# EasyEDA Pro project ProProject_IMUSensorNodes202312.epro, board 6_6_拼板20240123（带编号） (continued)
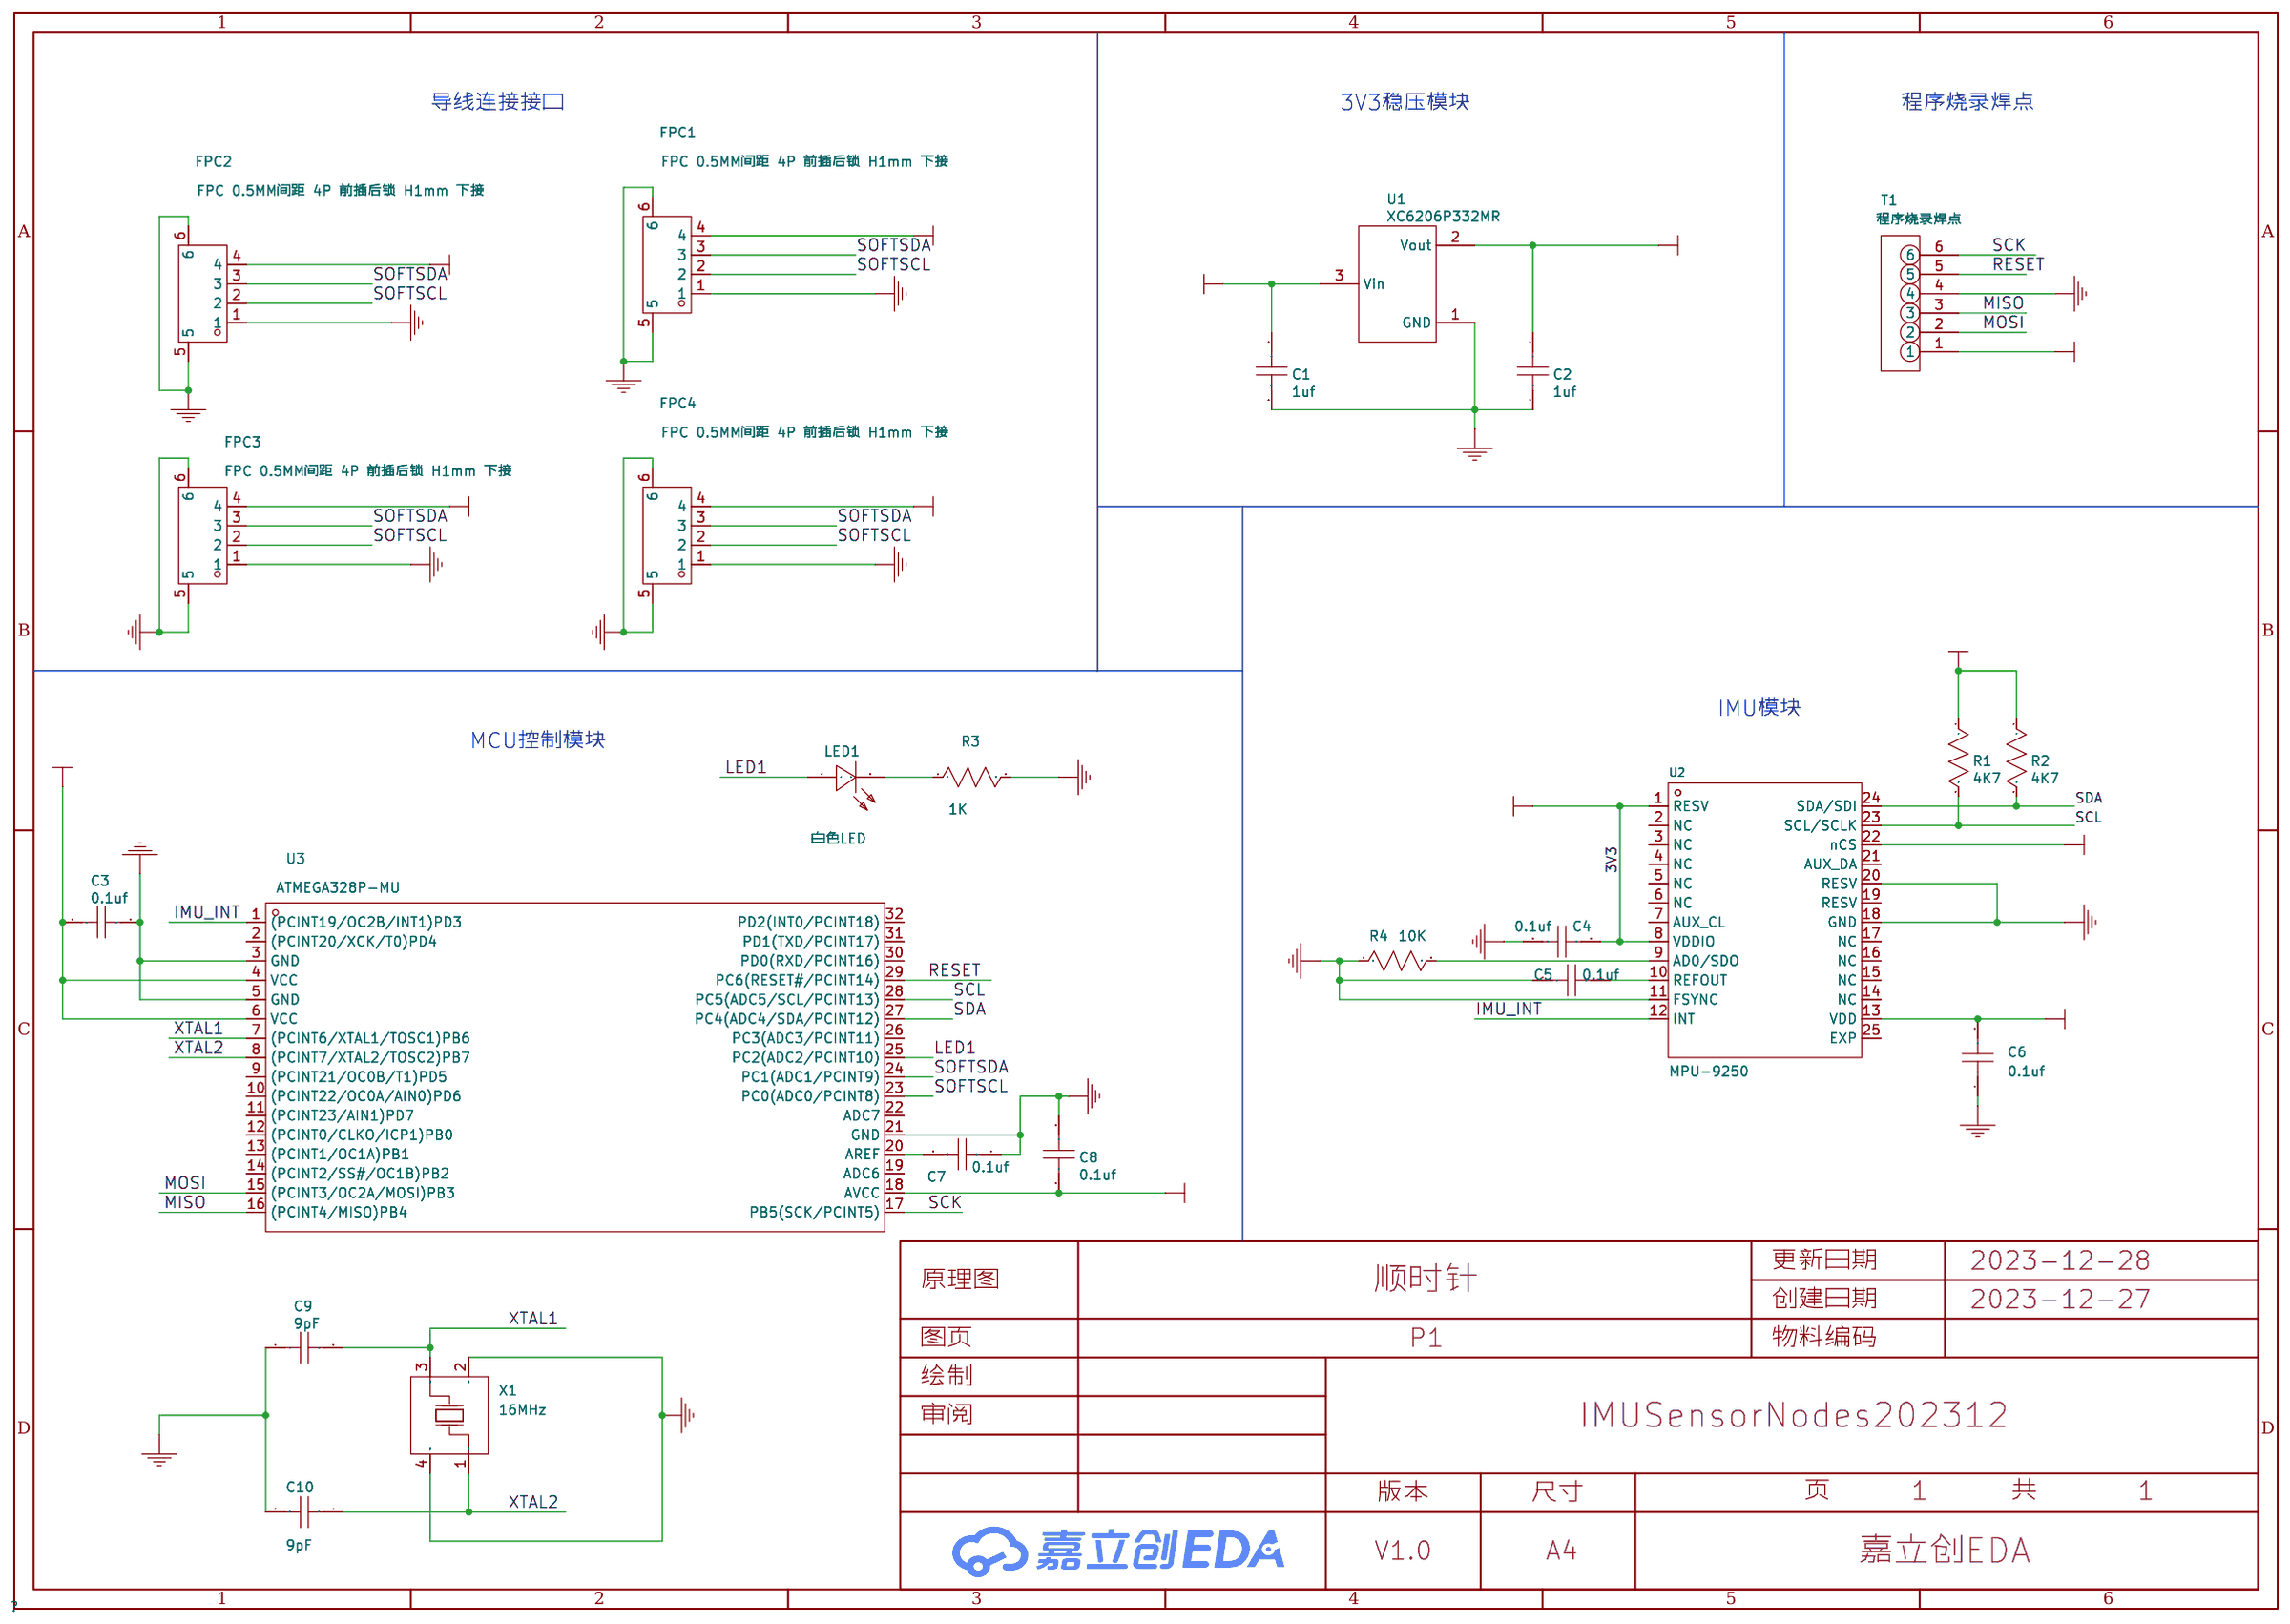
[diagram p0: schematic sheet]
## Routing (per net, layer and track width the routed paths; a pad name or vN(x,y) marks a point on that pad's centre or on a via; arc(x,y) is an arc through that point) (continued)
XTAL1: length 220.2
  Bottom Layer w0.2: v1(8.49,51.34) 8.49,50.14 6.89,48.54 6.13,48.54 5.6,48.02 Designator#803.7 ; Designator#910.7 73.92,6.87 74.2,7.14 74.91,7.14 76.74,8.97 v1(76.74,10.19) ; v1(76.74,23.91) 76.74,22.68 74.91,20.86 74.2,20.86 73.92,20.58 Designator#895.7 ; v1(8.49,65.05) 8.49,63.86 6.89,62.26 6.13,62.26 5.6,61.73 Designator#811.7 ; v1(35.79,37.62) 35.79,36.43 34.19,34.83 33.43,34.83 32.9,34.3 Designator#827.7 ; Designator#896.7 60.21,61.73 60.74,62.26 61.5,62.26 63.1,63.86 v1(63.1,65.05) ; v1(8.49,23.91) 8.49,22.71 6.89,21.11 6.13,21.11 5.6,20.58 Designator#837.7 ; Designator#808.7 32.9,61.73 33.43,62.26 34.19,62.26 35.79,63.86 v1(35.79,65.05) ; v1(49.43,10.19) 49.43,8.97 47.61,7.14 46.89,7.14 46.62,6.87 Designator#838.7 ; Designator#822.7 19.31,34.3 19.59,34.57 20.31,34.57 22.13,36.4 v1(22.13,37.62) ; v1(49.43,37.62) 49.43,36.4 47.61,34.57 46.89,34.57 46.62,34.3 Designator#839.7 ; Designator#913.7 19.31,6.87 19.59,7.14 20.31,7.14 22.13,8.97 v1(22.13,10.19) ; v1(63.1,10.19) 63.1,9 61.5,7.4 60.74,7.4 60.21,6.87 Designator#832.7 ; v1(63.1,23.91) 63.1,22.71 61.5,21.11 60.74,21.11 60.21,20.58 Designator#829.7 ; v1(22.13,23.91) 22.13,22.68 20.31,20.86 19.59,20.86 19.31,20.58 Designator#904.7 ; Designator#917.7 5.6,6.87 6.13,7.4 6.89,7.4 8.49,9 v1(8.49,10.19) ; v1(63.1,78.77) 63.1,77.58 61.5,75.97 60.74,75.97 60.21,75.45 Designator#903.7 ; Designator#810.7 73.92,75.45 74.2,75.72 74.91,75.72 76.74,77.55 v1(76.74,78.77) ; v1(35.79,78.77) 35.79,77.58 34.19,75.97 33.43,75.97 32.9,75.45 Designator#313.7 ; v1(22.13,78.77) 22.13,77.55 20.31,75.72 19.59,75.72 19.31,75.45 Designator#820.7 ; v1(76.74,65.05) 76.74,63.83 74.91,62 74.2,62 73.92,61.73 Designator#809.7 ; Designator#806.7 32.9,6.87 33.43,7.4 34.19,7.4 35.79,9 v1(35.79,10.19) ; v1(49.43,51.34) 49.43,50.11 47.61,48.29 46.89,48.29 46.62,48.02 Designator#322.7 ; v1(22.13,65.05) 22.13,63.83 20.31,62 19.59,62 19.31,61.73 Designator#835.7 ; v1(8.49,37.62) 8.49,36.43 6.89,34.83 6.13,34.83 5.6,34.3 Designator#440.7 ; Designator#325.7 5.6,75.45 6.13,75.97 6.89,75.97 8.49,77.58 v1(8.49,78.77) ; Designator#902.7 19.31,48.02 19.59,48.29 20.31,48.29 22.13,50.11 v1(22.13,51.34) ; Designator#892.7 60.21,34.3 60.74,34.83 61.5,34.83 63.1,36.43 v1(63.1,37.62) ; Designator#889.7 46.62,75.45 46.89,75.72 47.61,75.72 49.43,77.55 v1(49.43,78.77) ; v1(63.1,51.34) 63.1,50.14 61.5,48.54 60.74,48.54 60.21,48.02 Designator#920.7 ; Designator#906.7 73.92,48.02 74.2,48.29 74.91,48.29 76.74,50.11 v1(76.74,51.34) ; v1(49.43,23.91) 49.43,22.68 47.61,20.86 46.89,20.86 46.62,20.58 Designator#885.7 ; v1(35.79,51.34) 35.79,50.14 34.19,48.54 33.43,48.54 32.9,48.02 Designator#916.7 ; Designator#324.7 46.62,61.73 46.89,62 47.61,62 49.43,63.83 v1(49.43,65.05) ; Designator#801.7 73.92,34.3 74.2,34.57 74.91,34.57 76.74,36.4 v1(76.74,37.62) ; v1(35.79,23.91) 35.79,22.71 34.19,21.11 33.43,21.11 32.9,20.58 Designator#321.7
  Bottom Layer w0.254: Designator#593.2 35.84,10.34 35.84,10.19 ; 22.64,51.84 v1(22.13,51.34) ; Designator#449.2 8.54,37.78 8.54,37.62 ; 22.64,38.13 v1(22.13,37.62) ; 8.54,78.77 8.54,78.92 Designator#633.2 ; 63.15,37.62 63.15,37.78 Designator#489.2 ; 49.94,65.56 v1(49.43,65.05) ; 77.25,65.56 v1(76.74,65.05) ; 63.15,51.34 63.15,51.49 Designator#782.2 ; 49.94,79.28 v1(49.43,78.77) ; Designator#662.2 35.84,78.92 35.84,78.77 ; 63.15,10.19 63.15,10.34 Designator#613.2 ; 49.94,10.7 v1(49.43,10.19) ; Designator#762.2 35.84,51.49 35.84,51.34 ; 63.15,23.91 63.15,24.06 Designator#442.2 ; 49.94,38.13 v1(49.43,37.62) ; 49.94,24.41 v1(49.43,23.91) ; Designator#469.2 35.84,37.78 35.84,37.62 ; 8.54,23.91 8.54,24.06 Designator#519.2 ; 22.64,10.7 v1(22.13,10.19) ; 63.15,65.05 63.15,65.21 Designator#722.2 ; Designator#648.2 63.15,78.92 63.15,78.77 ; Designator#573.2 8.54,10.34 8.54,10.19 ; 35.84,23.91 35.84,24.06 Designator#539.2 ; 22.64,65.56 v1(22.13,65.05) ; 77.25,79.28 v1(76.74,78.77) ; 77.25,38.13 v1(76.74,37.62) ; 35.84,65.05 35.84,65.21 Designator#702.2 ; 77.25,51.84 v1(76.74,51.34) ; 77.25,10.7 v1(76.74,10.19) ; 8.54,65.05 8.54,65.21 Designator#682.2 ; 77.25,24.41 v1(76.74,23.91) ; 8.54,51.34 8.54,51.49 Designator#742.2 ; 22.64,24.41 v1(22.13,23.91) ; 22.64,79.28 v1(22.13,78.77) ; 49.94,51.84 v1(49.43,51.34)
XTAL2: length 162.6
  Top Layer w0.254: v1(22.76,22.51) 23.27,22.51 ; v1(50.07,49.94) 50.58,49.94 ; v1(77.37,77.37) 77.88,77.37 ; v1(22.76,49.94) 23.27,49.94 ; v1(77.37,22.51) 77.88,22.51 ; v1(50.07,22.51) 50.58,22.51 ; v1(22.76,63.66) 23.27,63.66 ; v1(50.07,77.37) 50.58,77.37 ; v1(22.76,36.22) 23.27,36.22 ; v1(77.37,8.79) 77.88,8.79 ; v1(77.37,63.66) 77.88,63.66 ; v1(50.07,63.66) 50.58,63.66 ; v1(22.76,77.37) 23.27,77.37 ; v1(50.07,8.79) 50.58,8.79 ; v1(77.37,49.94) 77.88,49.94 ; v1(50.07,36.22) 50.58,36.22 ; v1(77.37,36.22) 77.88,36.22 ; v1(22.76,8.79) 23.27,8.79
  Bottom Layer w0.2: v1(50.07,36.22) 49.69,36.22 47.27,33.81 Designator#839.8 ; Designator#889.8 47.27,74.95 49.69,77.37 v1(50.07,77.37) ; v1(63.66,35.97) 63.15,35.97 60.99,33.81 Designator#892.8 ; Designator#820.8 19.96,74.95 22.38,77.37 v1(22.76,77.37) ; Designator#885.8 47.27,20.09 49.69,22.51 v1(50.07,22.51) ; Designator#827.8 33.68,33.81 35.84,35.97 v1(36.35,35.97) ; Designator#806.8 33.68,6.37 35.84,8.54 v1(36.35,8.54) ; Designator#809.8 74.57,61.24 76.99,63.66 v1(77.37,63.66) ; v1(63.66,22.25) 63.15,22.25 60.99,20.09 Designator#829.8 ; v1(50.07,8.79) 49.69,8.79 47.27,6.37 Designator#838.8 ; v1(63.66,63.4) 63.15,63.4 60.99,61.24 Designator#896.8 ; v1(77.37,36.22) 76.99,36.22 74.57,33.81 Designator#801.8 ; Designator#917.8 6.38,6.37 8.54,8.54 v1(9.05,8.54) ; v1(77.37,8.79) 76.99,8.79 74.57,6.37 Designator#910.8 ; Designator#906.8 74.57,47.52 76.99,49.94 v1(77.37,49.94) ; v1(22.76,49.94) 22.38,49.94 19.96,47.52 Designator#902.8 ; Designator#810.8 74.57,74.95 76.99,77.37 v1(77.37,77.37) ; v1(36.35,77.12) 35.84,77.12 33.68,74.95 Designator#313.8 ; v1(36.35,63.4) 35.84,63.4 33.68,61.24 Designator#808.8 ; Designator#904.8 19.96,20.09 22.38,22.51 v1(22.76,22.51) ; Designator#895.8 74.57,20.09 76.99,22.51 v1(77.37,22.51) ; v1(9.05,77.12) 8.54,77.12 6.38,74.95 Designator#325.8 ; Designator#803.8 6.38,47.52 8.54,49.69 v1(9.05,49.69) ; v1(36.35,49.69) 35.84,49.69 33.68,47.52 Designator#916.8 ; Designator#822.8 19.96,33.81 22.38,36.22 v1(22.76,36.22) ; Designator#321.8 33.68,20.09 35.84,22.25 v1(36.35,22.25) ; Designator#832.8 60.99,6.37 63.15,8.54 v1(63.66,8.54) ; v1(22.76,63.66) 22.38,63.66 19.96,61.24 Designator#835.8 ; v1(9.05,63.4) 8.54,63.4 6.38,61.24 Designator#811.8 ; v1(9.05,22.25) 8.54,22.25 6.38,20.09 Designator#837.8 ; v1(9.05,35.97) 8.54,35.97 6.38,33.81 Designator#440.8 ; v1(22.76,8.79) 22.38,8.79 19.96,6.37 Designator#913.8 ; v1(50.07,63.66) 49.69,63.66 47.27,61.24 Designator#324.8 ; v1(63.66,49.69) 63.15,49.69 60.99,47.52 Designator#920.8 ; v1(50.07,49.94) 49.69,49.94 47.27,47.52 Designator#322.8 ; v1(63.66,77.12) 63.15,77.12 60.99,74.95 Designator#903.8
  Bottom Layer w0.254: v1(50.07,36.22) 50.3,36.45 Designator#478.1 ; v1(22.76,8.79) 22.99,9.02 Designator#582.1 ; v1(22.76,36.22) 22.99,36.45 Designator#458.1 ; Designator#622.1 77.6,9.02 v1(77.37,8.79) ; v1(77.37,36.22) 77.6,36.45 Designator#498.1 ; Designator#549.1 50.3,22.74 v1(50.07,22.51) ; Designator#443.1 77.6,22.74 v1(77.37,22.51) ; Designator#528.1 22.99,22.74 v1(22.76,22.51) ; Designator#791.1 77.6,50.17 v1(77.37,49.94) ; Designator#711.1 50.3,63.88 v1(50.07,63.66) ; Designator#731.1 77.6,63.88 v1(77.37,63.66) ; Designator#691.1 22.99,63.88 v1(22.76,63.66) ; Designator#751.1 22.99,50.17 v1(22.76,49.94) ; v1(50.07,8.79) 50.3,9.02 Designator#602.1 ; v1(50.07,49.94) 50.3,50.17 Designator#771.1 ; Designator#508.1 77.6,77.6 v1(77.37,77.37) ; v1(50.07,77.37) 50.3,77.6 Designator#671.1 ; v1(22.76,77.37) 22.99,77.6 Designator#649.1
$1N1156: length 14
  Bottom Layer w0.254: Designator#788.2 72.95,42.68 Designator#906.20 ; Designator#768.2 45.65,42.68 Designator#322.20 ; Designator#525.2 18.34,15.25 Designator#904.20 ; Designator#599.2 45.65,1.53 Designator#838.20 ; Designator#505.2 72.95,70.11 Designator#810.20 ; Designator#545.2 45.65,15.25 Designator#885.20 ; Designator#835.20 18.34,56.39 Designator#688.2 ; Designator#728.2 72.95,56.39 Designator#809.20 ; Designator#910.20 72.95,1.53 Designator#619.2 ; Designator#839.20 45.65,28.96 Designator#475.2 ; Designator#822.20 18.34,28.96 Designator#455.2 ; Designator#708.2 45.65,56.39 Designator#324.20 ; Designator#495.2 72.95,28.96 Designator#801.20 ; Designator#748.2 18.34,42.68 Designator#902.20 ; Designator#889.20 45.65,70.11 Designator#668.2 ; Designator#579.2 18.34,1.53 Designator#913.20 ; Designator#564.2 72.95,15.25 Designator#895.20 ; Designator#820.20 18.34,70.11 Designator#645.2
$1N1216: length 20.5
  Bottom Layer w0.254: Designator#402.2 20.27,64.49 Designator#915.9 ; 19.75,78.21 20.27,78.21 Designator#390.2 ; Designator#912.9 74.88,50.78 Designator#432.2 ; Designator#326.9 47.58,9.63 Designator#375.2 ; Designator#420.2 20.27,50.78 Designator#890.9 ; Designator#343.2 74.88,37.06 Designator#830.9 ; Designator#813.9 47.58,23.34 Designator#358.2 ; Designator#923.9 20.27,37.06 Designator#331.2 ; Designator#826.9 74.88,9.63 Designator#381.2 ; Designator#882.9 47.58,37.06 Designator#337.2 ; Designator#314.9 47.58,64.49 Designator#408.2 ; Designator#883.9 74.88,23.34 Designator#328.2 ; Designator#897.9 47.58,50.78 Designator#426.2 ; Designator#346.2 74.88,78.21 74.36,78.21 ; Designator#414.2 74.88,64.49 Designator#881.9 ; Designator#323.9 20.27,9.63 Designator#369.2 ; Designator#836.9 20.27,23.34 Designator#352.2 ; Designator#396.2 47.58,78.21 47.05,78.21
$1N1217: length 16.3
  Bottom Layer w0.254: Designator#813.10 47.96,22.94 ; Designator#314.10 47.96,64.09 ; Designator#890.10 20.65,50.38 ; Designator#836.10 20.65,22.94 ; Designator#826.10 75.26,9.23 ; Designator#886.10 20.65,77.81 ; Designator#880.10 47.96,77.81 ; Designator#830.10 75.26,36.66 ; Designator#326.10 47.96,9.23 ; Designator#881.10 75.26,64.09 ; Designator#882.10 47.96,36.66 ; Designator#918.10 75.26,77.81 ; Designator#912.10 75.26,50.38 ; Designator#323.10 20.65,9.23 ; Designator#915.10 20.65,64.09 ; Designator#883.10 75.26,22.94 ; Designator#923.10 20.65,36.66 ; Designator#897.10 47.96,50.38
$1N1698: length 22.8
  Bottom Layer w0.2: 60.64,78.21 61.29,78.21 Designator#387.2 ; Designator#378.2 61.29,9.63 Designator#911.9 ; Designator#393.2 33.99,78.21 33.34,78.21 ; Designator#438.9 6.68,9.63 Designator#366.2 ; Designator#900.9 61.29,23.34 Designator#361.2 ; Designator#919.9 61.29,37.06 Designator#340.2 ; Designator#429.2 61.29,50.78 Designator#877.9 ; Designator#349.2 6.68,23.34 Designator#318.9 ; Designator#334.2 33.99,37.06 Designator#921.9 ; Designator#888.9 6.68,50.78 Designator#417.2 ; Designator#909.9 33.99,23.34 Designator#355.2 ; Designator#411.2 61.29,64.49 Designator#819.9 ; Designator#435.2 6.68,37.06 Designator#317.9 ; Designator#399.2 6.68,64.49 Designator#818.9 ; Designator#831.9 33.99,9.63 Designator#372.2 ; Designator#384.2 6.68,78.21 6.03,78.21 ; Designator#878.9 33.99,64.49 Designator#405.2 ; Designator#319.9 33.99,50.78 Designator#423.2
$1N1725: length 20.1
  Bottom Layer w0.2: Designator#888.10 7.04,50.38 Designator#744.2 ; Designator#635.2 7.04,77.81 Designator#437.10 ; Designator#595.2 34.35,9.23 Designator#831.10 ; Designator#318.10 7.04,22.94 Designator#521.2 ; Designator#317.10 7.04,36.66 Designator#451.2 ; Designator#909.10 34.35,22.94 Designator#541.2 ; Designator#654.2 61.65,77.81 Designator#814.10 ; Designator#560.2 61.65,22.94 Designator#900.10 ; Designator#818.10 7.04,64.09 Designator#684.2 ; Designator#491.2 61.65,36.66 Designator#919.10 ; Designator#819.10 61.65,64.09 Designator#724.2 ; Designator#664.2 34.35,77.81 Designator#901.10 ; Designator#704.2 34.35,64.09 Designator#878.10 ; Designator#784.2 61.65,50.38 Designator#877.10 ; Designator#921.10 34.35,36.66 Designator#471.2 ; Designator#575.2 7.04,9.23 Designator#438.10 ; Designator#615.2 61.65,9.23 Designator#911.10 ; Designator#319.10 34.35,50.38 Designator#764.2

## Copper pours and planes (outline as drawn; the poured copper is in the pictures)
5V on Top Layer: 18.97,75.34 20.48,75.34 20.48,73.82 18.97,73.82
5V on Top Layer: 73.58,75.34 75.09,75.34 75.09,73.82 73.58,73.82
5V on Top Layer: 5.13,75.46 6.88,75.46 6.88,73.67 5.13,73.67
5V on Top Layer: 5.13,6.88 6.88,6.88 6.88,5.09 5.13,5.09
5V on Top Layer: 5.13,61.74 6.88,61.74 6.88,59.95 5.13,59.95
5V on Top Layer: 18.97,20.48 20.48,20.48 20.48,18.95 18.97,18.95
5V on Top Layer: 5.13,34.31 6.88,34.31 6.88,32.52 5.13,32.52
5V on Top Layer: 73.58,47.91 75.09,47.91 75.09,46.38 73.58,46.38
5V on Top Layer: 32.44,75.46 34.19,75.46 34.19,73.67 32.44,73.67
5V on Top Layer: 5.13,20.59 6.88,20.59 6.88,18.81 5.13,18.81
5V on Top Layer: 32.44,61.74 34.19,61.74 34.19,59.95 32.44,59.95
5V on Top Layer: 46.27,47.91 47.78,47.91 47.78,46.38 46.27,46.38
5V on Top Layer: 46.27,75.34 47.78,75.34 47.78,73.82 46.27,73.82
5V on Top Layer: 59.74,75.46 61.49,75.46 61.49,73.67 59.74,73.67
5V on Top Layer: 18.97,34.19 20.48,34.19 20.48,32.67 18.97,32.67
5V on Top Layer: 59.74,34.31 61.49,34.31 61.49,32.52 59.74,32.52
5V on Top Layer: 5.13,48.02 6.88,48.02 6.88,46.24 5.13,46.24
5V on Top Layer: 32.44,6.88 34.19,6.88 34.19,5.09 32.44,5.09
5V on Top Layer: 46.27,61.63 47.78,61.63 47.78,60.1 46.27,60.1
5V on Top Layer: 32.44,48.02 34.19,48.02 34.19,46.24 32.44,46.24
5V on Top Layer: 59.74,61.74 61.49,61.74 61.49,59.95 59.74,59.95
5V on Top Layer: 32.44,20.59 34.19,20.59 34.19,18.81 32.44,18.81
5V on Top Layer: 73.58,20.48 75.09,20.48 75.09,18.95 73.58,18.95
5V on Top Layer: 46.27,20.48 47.78,20.48 47.78,18.95 46.27,18.95
5V on Top Layer: 73.58,6.76 75.09,6.76 75.09,5.24 73.58,5.24
5V on Top Layer: 46.27,6.76 47.78,6.76 47.78,5.24 46.27,5.24
5V on Top Layer: 18.97,61.63 20.48,61.63 20.48,60.1 18.97,60.1
5V on Top Layer: 46.27,34.19 47.78,34.19 47.78,32.67 46.27,32.67
5V on Top Layer: 73.58,34.19 75.09,34.19 75.09,32.67 73.58,32.67
5V on Top Layer: 59.74,20.59 61.49,20.59 61.49,18.81 59.74,18.81
5V on Top Layer: 32.44,34.31 34.19,34.31 34.19,32.52 32.44,32.52
5V on Top Layer: 59.74,48.02 61.49,48.02 61.49,46.24 59.74,46.24
5V on Top Layer: 18.97,47.91 20.48,47.91 20.48,46.38 18.97,46.38
5V on Top Layer: 73.58,61.63 75.09,61.63 75.09,60.1 73.58,60.1
5V on Top Layer: 18.97,6.76 20.48,6.76 20.48,5.24 18.97,5.24
5V on Top Layer: 59.74,6.88 61.49,6.88 61.49,5.09 59.74,5.09
GND on Top Layer: 13.62,25.81 25.69,25.81 25.69,13.75 13.62,13.75
GND on Top Layer: 68.23,66.96 80.29,66.96 80.29,54.89 68.23,54.89
GND on Top Layer: 57.36,60.15 59.34,60.15 59.34,57.68 57.36,57.68
GND on Top Layer: 54.51,12.09 66.71,12.09 66.71,-0.1 54.51,-0.1
GND on Top Layer: 54.51,66.96 66.71,66.96 66.71,54.77 54.51,54.77
GND on Top Layer: 30.06,60.15 32.04,60.15 32.04,57.68 30.06,57.68
GND on Top Layer: 57.36,32.72 59.34,32.72 59.34,30.25 57.36,30.25
GND on Top Layer: 68.23,12.09 80.29,12.09 80.29,0.03 68.23,0.03
GND on Top Layer: 2.75,46.44 4.73,46.44 4.73,43.97 2.75,43.97
GND on Top Layer: 54.51,53.24 66.71,53.24 66.71,41.05 54.51,41.05
GND on Top Layer: 30.06,73.87 32.04,73.87 32.04,71.4 30.06,71.4
GND on Top Layer: -0.1,25.81 12.1,25.81 12.1,13.62 -0.1,13.62
GND on Top Layer: -0.1,80.67 12.1,80.67 12.1,68.48 -0.1,68.48
GND on Top Layer: 13.62,80.67 25.69,80.67 25.69,68.61 13.62,68.61
GND on Top Layer: 40.92,66.96 52.99,66.96 52.99,54.89 40.92,54.89
GND on Top Layer: 40.92,12.09 52.99,12.09 52.99,0.03 40.92,0.03
GND on Top Layer: -0.1,66.96 12.1,66.96 12.1,54.77 -0.1,54.77
GND on Top Layer: 68.23,53.24 80.29,53.24 80.29,41.18 68.23,41.18
GND on Top Layer: 40.92,39.53 52.99,39.53 52.99,27.46 40.92,27.46
GND on Top Layer: 2.75,19 4.73,19 4.73,16.53 2.75,16.53
GND on Top Layer: 27.21,80.67 39.4,80.67 39.4,68.48 27.21,68.48
GND on Top Layer: 30.06,46.44 32.04,46.44 32.04,43.97 30.06,43.97
GND on Top Layer: 30.06,5.29 32.04,5.29 32.04,2.82 30.06,2.82
GND on Top Layer: 13.62,39.53 25.69,39.53 25.69,27.46 13.62,27.46
GND on Top Layer: 68.23,25.81 80.29,25.81 80.29,13.75 68.23,13.75
GND on Top Layer: -0.1,53.24 12.1,53.24 12.1,41.05 -0.1,41.05
GND on Top Layer: 40.92,80.67 52.99,80.67 52.99,68.61 40.92,68.61
GND on Top Layer: 27.21,53.24 39.4,53.24 39.4,41.05 27.21,41.05
GND on Top Layer: 57.36,19 59.34,19 59.34,16.53 57.36,16.53
GND on Top Layer: -0.1,12.09 12.1,12.09 12.1,-0.1 -0.1,-0.1
GND on Top Layer: 13.62,66.96 25.69,66.96 25.69,54.89 13.62,54.89
GND on Top Layer: 57.36,73.87 59.34,73.87 59.34,71.4 57.36,71.4
GND on Top Layer: 40.92,25.81 52.99,25.81 52.99,13.75 40.92,13.75
GND on Top Layer: 54.51,39.53 66.71,39.53 66.71,27.33 54.51,27.33
GND on Top Layer: 27.21,66.96 39.4,66.96 39.4,54.77 27.21,54.77
GND on Top Layer: 57.36,5.29 59.34,5.29 59.34,2.82 57.36,2.82
GND on Top Layer: 2.75,60.15 4.73,60.15 4.73,57.68 2.75,57.68
GND on Top Layer: 54.51,25.81 66.71,25.81 66.71,13.62 54.51,13.62
GND on Top Layer: 54.51,80.67 66.71,80.67 66.71,68.48 54.51,68.48
GND on Top Layer: 13.62,12.09 25.69,12.09 25.69,0.03 13.62,0.03
GND on Top Layer: 40.92,53.24 52.99,53.24 52.99,41.18 40.92,41.18
GND on Top Layer: -0.1,39.53 12.1,39.53 12.1,27.33 -0.1,27.33
GND on Top Layer: 30.06,32.72 32.04,32.72 32.04,30.25 30.06,30.25
GND on Top Layer: 27.21,25.81 39.4,25.81 39.4,13.62 27.21,13.62
GND on Top Layer: 2.75,32.72 4.73,32.72 4.73,30.25 2.75,30.25
GND on Top Layer: 13.62,53.24 25.69,53.24 25.69,41.18 13.62,41.18
GND on Top Layer: 2.75,73.87 4.73,73.87 4.73,71.4 2.75,71.4
GND on Top Layer: 27.21,12.09 39.4,12.09 39.4,-0.1 27.21,-0.1
GND on Top Layer: 2.75,5.29 4.73,5.29 4.73,2.82 2.75,2.82
GND on Top Layer: 57.36,46.44 59.34,46.44 59.34,43.97 57.36,43.97
GND on Top Layer: 27.21,39.53 39.4,39.53 39.4,27.33 27.21,27.33
GND on Top Layer: 68.23,80.67 80.29,80.67 80.29,68.61 68.23,68.61
GND on Top Layer: 68.23,39.53 80.29,39.53 80.29,27.46 68.23,27.46
GND on Top Layer: 30.06,19 32.04,19 32.04,16.53 30.06,16.53
GND on Bottom Layer: 13.62,66.96 25.69,66.96 25.69,54.89 13.62,54.89
GND on Bottom Layer: 54.51,66.96 66.71,66.96 66.71,54.77 54.51,54.77
GND on Bottom Layer: 13.62,12.09 25.69,12.09 25.69,0.03 13.62,0.03
GND on Bottom Layer: 40.92,12.09 52.99,12.09 52.99,0.03 40.92,0.03
GND on Bottom Layer: 27.21,39.53 39.4,39.53 39.4,27.33 27.21,27.33
GND on Bottom Layer: 27.21,12.09 39.4,12.09 39.4,-0.1 27.21,-0.1
GND on Bottom Layer: 13.62,80.67 25.69,80.67 25.69,68.61 13.62,68.61
GND on Bottom Layer: 68.23,39.53 80.29,39.53 80.29,27.46 68.23,27.46
GND on Bottom Layer: -0.1,25.81 12.1,25.81 12.1,13.62 -0.1,13.62
GND on Bottom Layer: 54.51,39.53 66.71,39.53 66.71,27.33 54.51,27.33
GND on Bottom Layer: 13.62,25.81 25.69,25.81 25.69,13.75 13.62,13.75
GND on Bottom Layer: 54.51,12.09 66.71,12.09 66.71,-0.1 54.51,-0.1
GND on Bottom Layer: 68.23,53.24 80.29,53.24 80.29,41.18 68.23,41.18
GND on Bottom Layer: 54.51,53.24 66.71,53.24 66.71,41.05 54.51,41.05
GND on Bottom Layer: 54.51,80.67 66.71,80.67 66.71,68.48 54.51,68.48
GND on Bottom Layer: 13.62,53.24 25.69,53.24 25.69,41.18 13.62,41.18
GND on Bottom Layer: 40.92,25.81 52.99,25.81 52.99,13.75 40.92,13.75
GND on Bottom Layer: -0.1,66.96 12.1,66.96 12.1,54.77 -0.1,54.77
GND on Bottom Layer: 27.21,25.81 39.4,25.81 39.4,13.62 27.21,13.62
GND on Bottom Layer: 13.62,39.53 25.69,39.53 25.69,27.46 13.62,27.46
GND on Bottom Layer: 27.21,80.67 39.4,80.67 39.4,68.48 27.21,68.48
GND on Bottom Layer: 68.23,66.96 80.29,66.96 80.29,54.89 68.23,54.89
GND on Bottom Layer: 54.51,25.81 66.71,25.81 66.71,13.62 54.51,13.62
GND on Bottom Layer: 40.92,80.67 52.99,80.67 52.99,68.61 40.92,68.61
GND on Bottom Layer: 40.92,39.53 52.99,39.53 52.99,27.46 40.92,27.46
GND on Bottom Layer: -0.1,12.09 12.1,12.09 12.1,-0.1 -0.1,-0.1
GND on Bottom Layer: -0.1,39.53 12.1,39.53 12.1,27.33 -0.1,27.33
GND on Bottom Layer: 68.23,80.67 80.29,80.67 80.29,68.61 68.23,68.61
GND on Bottom Layer: 40.92,53.24 52.99,53.24 52.99,41.18 40.92,41.18
GND on Bottom Layer: 40.92,66.96 52.99,66.96 52.99,54.89 40.92,54.89
GND on Bottom Layer: -0.1,53.24 12.1,53.24 12.1,41.05 -0.1,41.05
GND on Bottom Layer: 27.21,53.24 39.4,53.24 39.4,41.05 27.21,41.05
GND on Bottom Layer: 27.21,66.96 39.4,66.96 39.4,54.77 27.21,54.77
GND on Bottom Layer: 68.23,25.81 80.29,25.81 80.29,13.75 68.23,13.75
GND on Bottom Layer: 68.23,12.09 80.29,12.09 80.29,0.03 68.23,0.03
GND on Bottom Layer: -0.1,80.67 12.1,80.67 12.1,68.48 -0.1,68.48

Small or netless copper shapes (teardrops, artwork), in the pictures only: 36 on Top Layer

## Text on the board
Top Silkscreen Layer: X | Y
